# EasyEDA Pro project Access Control Core.eprj, schematic Card Reader (continued)
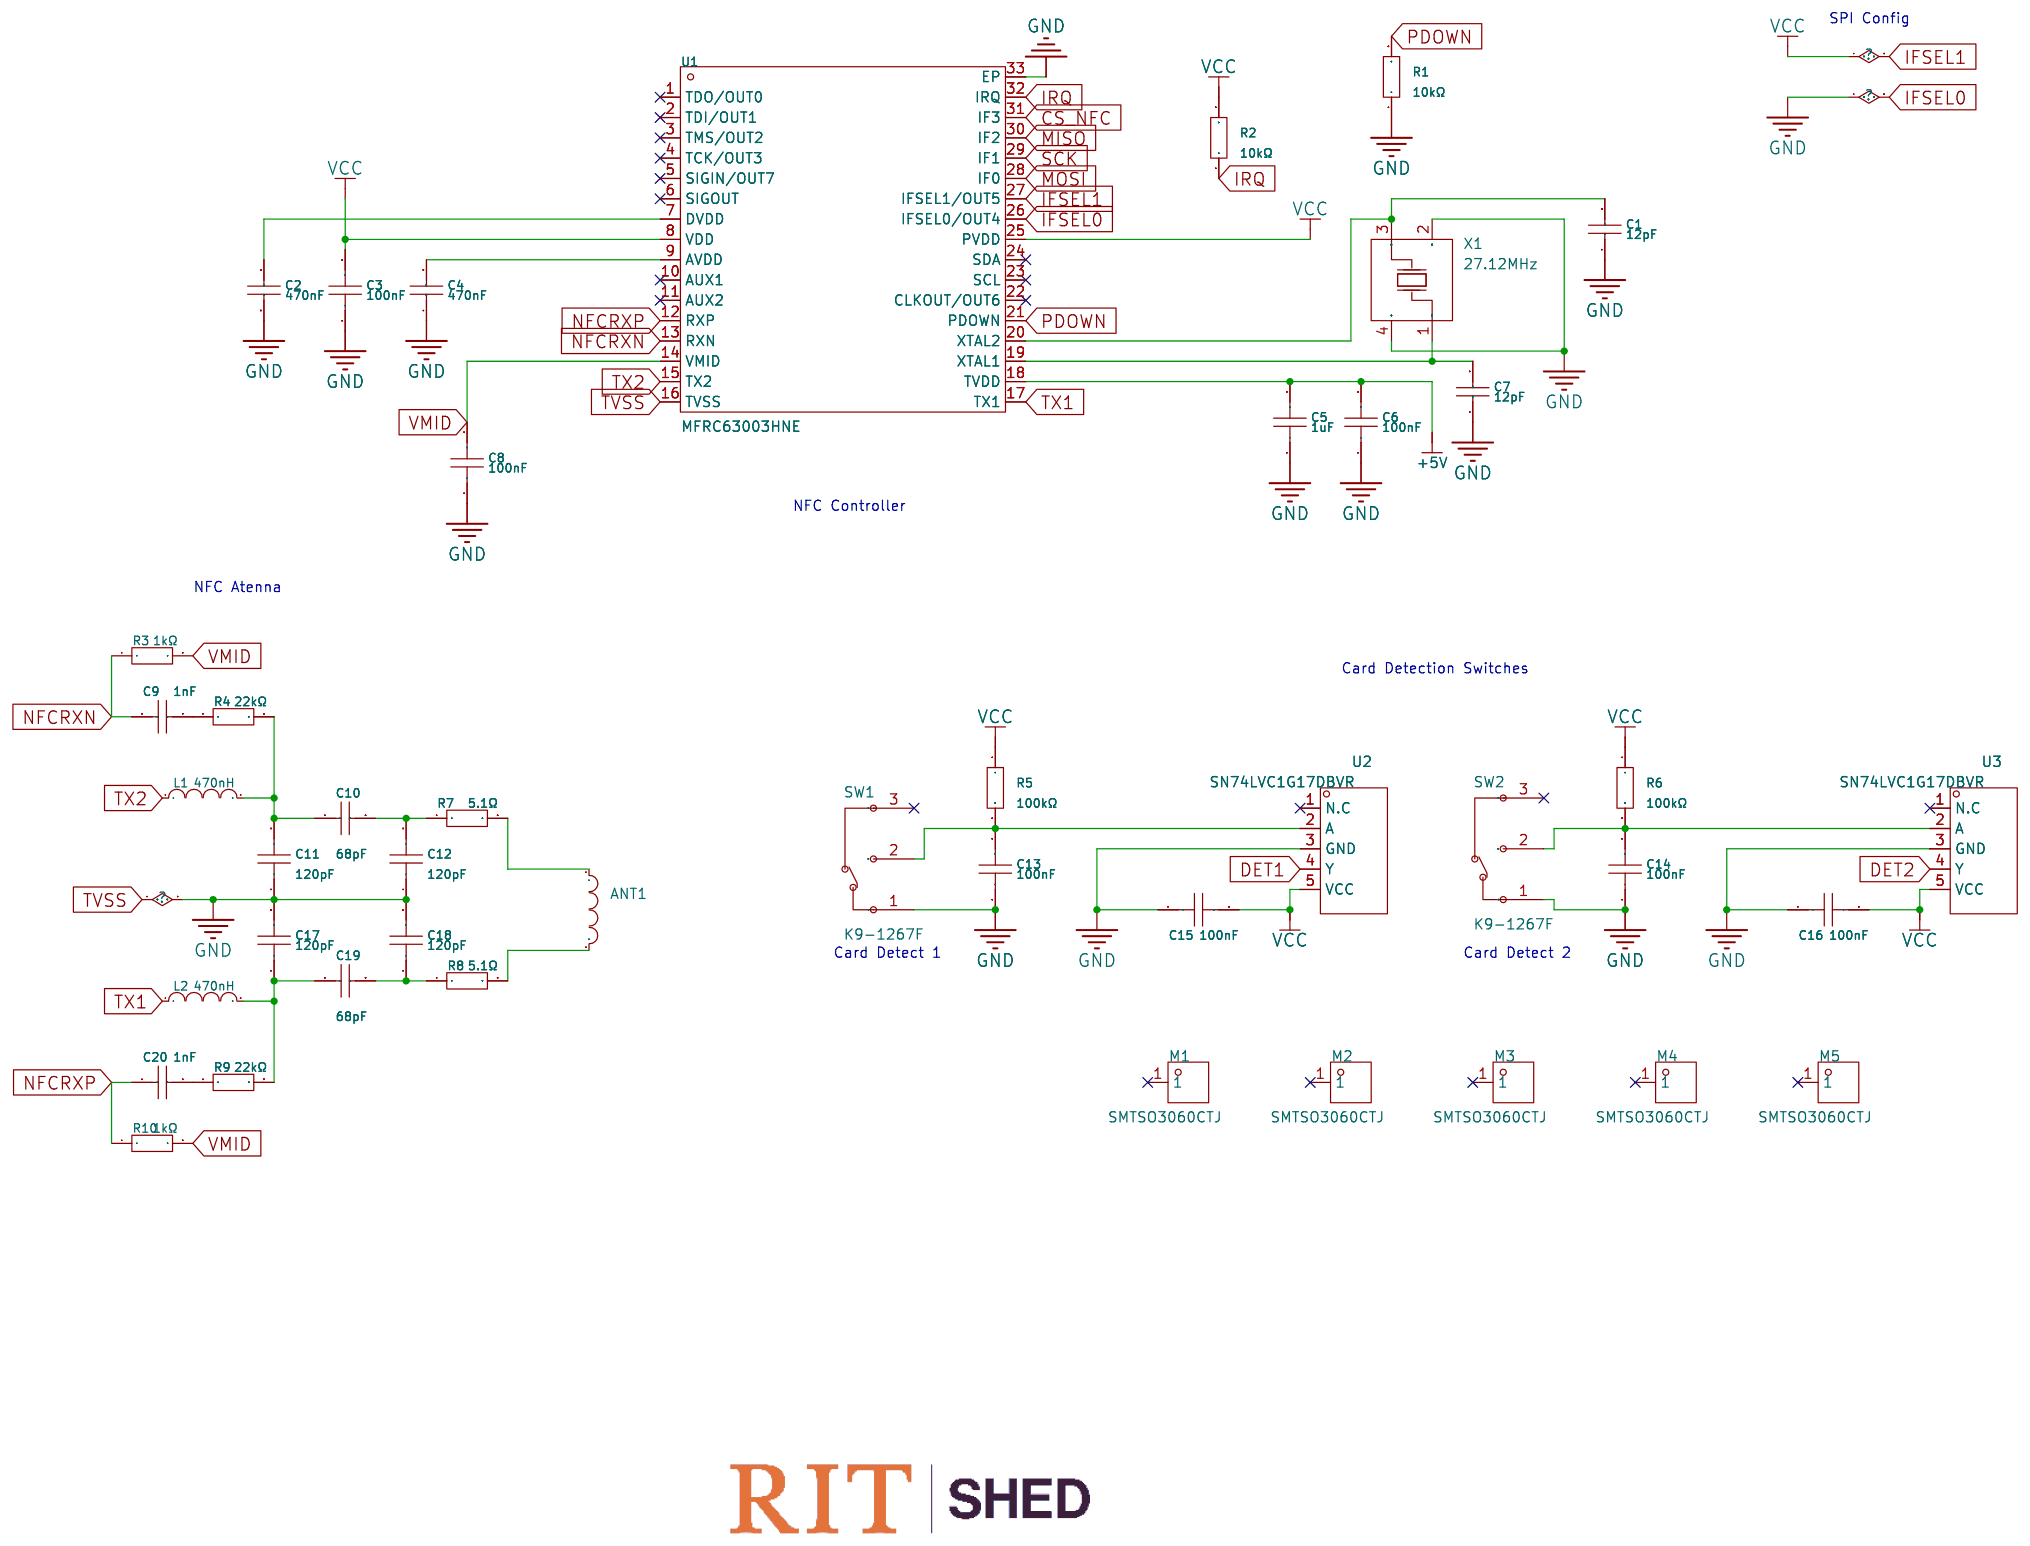
[diagram p0: NFC Reader]
## Library data of the parts (continued)
R38 = RTT031242FTP: Type:Thick Film Resistors Resistance: Tolerance:±1% Tolerance:±1% Power(Watts): Overload Voltage (Max): Temperature Coefficient:±100ppm/℃ Temperature Coefficient:±100ppm/℃ Operating Temperature Range:-55℃~+155℃ Operating Temperature Range:-55℃~+155℃; LCSC Part Name: 厚膜电阻 12.4kΩ ±1% 100mW; Supplier Part: C103261; Manufacturer: RALEC(旺诠); Supplier Footprint: 0603; JLCPCB Part Class: Extended Part; Datasheet: https://atta.szlcsc.com/upload/public/pdf/source/20191219/C158410_884373A5B7E1BC76BF57BC45A946C093.pdf; Supplier: LCSC; Type: Thick Film Resistors; Tolerance: ±1%; Temperature Coefficient: ±100ppm/℃; Operating Temperature Range: -55℃~+155℃
R40 R41 R47 R48 = RC0603DR-0749R9L: 100mW Thick Film Resistors ±100ppm/℃ ±0.5% 49.9Ω 0603  Chip Resistor - Surface Mount ROHS; LCSC Part Name: C859049; Supplier Part: C859049; Manufacturer: UNI-ROYAL(厚声); Manufacturer Part: 0603WAF1002T5E; Supplier Footprint: 0603; JLCPCB Part Class: Extended Part; Datasheet: https://atta.szlcsc.com/upload/public/pdf/source/20200306/C422600_1E6D84923E4A46A82E41ADD87F860B5C.pdf; Supplier: LCSC; Type: Thick Film Resistors; Tolerance: ±1%; Temperature Coefficient: ±100ppm/℃; Operating Temperature Range: -55℃~+155℃
R43 = 0603WAF100JT5E: Type:Thick Film Resistors Resistance:10Ω Tolerance:±1% Tolerance:±1% Power(Watts): Overload Voltage (Max): Temperature Coefficient:±400ppm/℃ Temperature Coefficient:±400ppm/℃ Operating Temperature Range:-55℃~+155℃ Operating Temperature Range:-55℃~+155℃; LCSC Part Name: 10Ω ±1% 100mW 厚膜电阻; Supplier Part: C22859; Manufacturer: UNI-ROYAL(厚声); Supplier Footprint: 0603; JLCPCB Part Class: Basic Part; Datasheet: https://atta.szlcsc.com/upload/public/pdf/source/20200306/C422600_1E6D84923E4A46A82E41ADD87F860B5C.pdf; Supplier: LCSC; Type: Thick Film Resistors; Tolerance: ±1%; Temperature Coefficient: ±400ppm/℃; Operating Temperature Range: -55℃~+155℃
R3 R10 R33 R34 R36 R44 R46 R58 R59 R61 = 0603WAF1001T5E: Type:Thick Film Resistors Resistance:1kΩ Tolerance:±1% Tolerance:±1% Power(Watts): Overload Voltage (Max): Temperature Coefficient:±100ppm/℃ Temperature Coefficient:±100ppm/℃ Operating Temperature Range:-55℃~+155℃ Operating Temperature Range:-55℃~+155℃; LCSC Part Name: 1kΩ ±1% 100mW 厚膜电阻; Supplier Part: C21190; Manufacturer: UNI-ROYAL(厚声); Supplier Footprint: 0603; JLCPCB Part Class: Basic Part; Datasheet: https://atta.szlcsc.com/upload/public/pdf/source/20200306/C422600_1E6D84923E4A46A82E41ADD87F860B5C.pdf; Supplier: LCSC; Type: Thick Film Resistors; Tolerance: ±1%; Temperature Coefficient: ±100ppm/℃; Operating Temperature Range: -55℃~+155℃
R45 = 0603WAF1004T5E: Type:Thick Film Resistors Resistance:1MΩ Tolerance:±1% Tolerance:±1% Power(Watts): Overload Voltage (Max): Temperature Coefficient:±100ppm/℃ Temperature Coefficient:±100ppm/℃ Operating Temperature Range:-55℃~+155℃ Operating Temperature Range:-55℃~+155℃; LCSC Part Name: 1MΩ ±1% 100mW 厚膜电阻; Supplier Part: C22935; Manufacturer: UNI-ROYAL(厚声); Supplier Footprint: 0603; JLCPCB Part Class: Basic Part; Datasheet: https://atta.szlcsc.com/upload/public/pdf/source/20200306/C422600_1E6D84923E4A46A82E41ADD87F860B5C.pdf; Supplier: LCSC; Type: Thick Film Resistors; Tolerance: ±1%; Temperature Coefficient: ±100ppm/℃; Operating Temperature Range: -55℃~+155℃
U16 = SN74AHC1G125DBVR: Input type:- output type:Tri-State Supply Voltage:2V~5.5V Supply Voltage:2V~5.5V Number of Elements:1 Number of Bits per Element:1 Sink Current:8mA Source Current:8mA Logic Family:74AHC Operating Temperature:-40℃~+125℃ Operating Temperature:-40℃~+125℃; Supplier Part: C7468; Manufacturer: TI(德州仪器); Supplier Footprint: SOT-23-5; JLCPCB Part Class: Extended Part; Datasheet: https://www.ti.com/cn/lit/gpn/sn74ahc1g125; Supplier: LCSC; output type: Tri-State; Supply Voltage: 2V~5.5V; Number of Elements: 1; Number of Bits per Element: 1; Sink Current: 8mA; Source Current: 8mA; Logic Family: 74AHC; Operating Temperature: -40℃~+125℃
U17 = W5500: LCSC Part Name: 硬连线TCP/IP嵌入式以太网控制器; Supplier Part: C32843; Manufacturer: WIZNET; Supplier Footprint: LQFP-48(7x7); JLCPCB Part Class: Extended Part; Datasheet: https://atta.szlcsc.com/upload/public/pdf/source/20230714/E10C32B058E0BA54FCE1C1556BE10C07.pdf; Supplier: LCSC
X2 = X322525MOB4SI: Type:Surface Mount Crystal Frequency:25MHz Normal temperature Frequency Tolerance:±10ppm Normal temperature Frequency Tolerance:±10ppm Load Capacitance:12pF Frequency Stability:±20ppm Frequency Stability:±20ppm Operating Temperature:-40℃~+85℃ Operating Te; LCSC Part Name: YSX321SL 25MHZ 4P 3225 12PF ±10PPM -40~85℃ (±20PPM); Supplier Part: C9006; Manufacturer: YXC(扬兴晶振); Supplier Footprint: SMD3225-4P; JLCPCB Part Class: Basic Part; Datasheet: https://atta.szlcsc.com/upload/public/pdf/source/20240329/19D5F850207469550BEB00D7DFEDBC7A.pdf; Supplier: LCSC; Type: Surface Mount Crystal; Normal temperature Frequency Tolerance: ±10ppm; Load Capacitance: 12pF; Frequency Stability: ±20ppm; Operating Temperature: -40℃~+85℃
C21 C22 C56 = CL31A476MPHNNNE: LCSC Part Name: 47uF ±20% 10V; Supplier Part: C96123; Manufacturer: SAMSUNG(三星); Supplier Footprint: 1206; Datasheet: https://item.szlcsc.com/datasheet/CL31A476MPHNNNE/97327.html; Supplier: LCSC; Tolerance: ±20%; Voltage Rating: 10V; Temperature Coefficient: X5R
C5 C92 C100 C102 = CL10A105KB8NNNC: Capacitance: Tolerance:±10% Tolerance:±10% Voltage Rated: Temperature Coefficient:; LCSC Part Name: 1uF ±10% 50V; Supplier Part: C15849; Manufacturer: SAMSUNG(三星); Supplier Footprint: 0603; JLCPCB Part Class: Basic Part; Datasheet: https://atta.szlcsc.com/upload/public/pdf/source/20160218/1457707763339.pdf; Supplier: LCSC; Tolerance: ±10%
CN2 = B-3002N14P-0110: LCSC Part Name: 2mm 2x7P 排数:2 每排P数:7; Supplier Part: C383681; Manufacturer: Ckmtw(灿科盟); Supplier Footprint: SMD,P=2mm; JLCPCB Part Class: Extended Part; Datasheet: https://item.szlcsc.com/datasheet/B-3002N14P-0110/356941.html; Supplier: LCSC; Connector Type: IDC Header; Pitch: 2mm; Number of Positions or Pins: 2x7P; Holder Type: Surface Mount,Vertical; Row Spacing: 2mm; Number of Rows: 2; Number of PINs Per Row: 7; Contact Material: Brass; Contact Plating: Gold
F1 F2 F5 F7 = SMD1206B050TF: LCSC Part Name: 6V 500mA 贴片自恢复; Supplier Part: C269115; Manufacturer: Brightking(君耀电子); Supplier Footprint: 1206; JLCPCB Part Class: Extended Part; Datasheet: https://item.szlcsc.com/datasheet/SMD1206B050TF/258573.html; Supplier: LCSC; Voltage - Max: 6V; Current - Max: 100A; Hold Current: 500mA; Trip Current: 1A; Power Dissipation: 600mW; Resistance - Initial (Ri) (Min): 150mΩ; Resistance - Post Trip (R1) (Max): 700mΩ; Time to Trip(Max): 100ms; Operating Temperature: -40℃~+85℃; Length: 3.4mm; Width: 1.8mm; Height: 0.85mm
J1 = HC-GAP-ACF012-1T: LCSC Part Name: Type-C 母 侧插; Supplier Part: C2894906; Manufacturer: HCTL(华灿天禄); Supplier Footprint: 插件; Datasheet: https://item.szlcsc.com/datasheet/HC-GAP-ACF012-1T/3132582.html; Supplier: LCSC; Connector Type: Type-C; Gender: Female; Mounting Type: Vertical, Flag; Number of Contacts: 14P; Number of Ports: 1; Current Rating-Power: 5A; Voltage Rating: 5V; Connect-Disconnect Life: 10,000 cycles; Detection color: Black; Operating Temperature: -25℃~+85℃
R5 R6 R11 = 0603WAF1003T5E: Type:Thick Film Resistor Resistance:100kΩ Tolerance:±1% Tolerance:±1% Power(Watts):100mW Voltage-Supply(Max):75V Temperature Coefficient:±100ppm/℃ Temperature Coefficient:±100ppm/℃ Operating Temperature:-55℃~+155℃ Operating Temperature:-55℃~+155℃; LCSC Part Name: 100kΩ ±1% 100mW 厚膜电阻; Supplier Part: C25803; Manufacturer: UNI-ROYAL(厚声); Supplier Footprint: 0603; JLCPCB Part Class: Basic Part; Datasheet: https://item.szlcsc.com/datasheet/0603WAF1003T5E/26546.html; Supplier: LCSC; Type: Thick Film Resistor; Tolerance: ±1%; Power(Watts): 100mW; Voltage-Supply(Max): 75V; Temperature Coefficient: ±100ppm/℃; Operating Temperature: -55℃~+155℃; Operating Temperature Range: -55℃~+155℃
R13 R14 = 0603WAF5101T5E: LCSC Part Name: 5.1kΩ ±1% 100mW 厚膜电阻; Supplier Part: C23186; Manufacturer: UNI-ROYAL(厚声); Supplier Footprint: 0603; Datasheet: https://item.szlcsc.com/datasheet/0603WAF5101T5E/23913.html; Supplier: LCSC; Type: Thick Film Resistor; Tolerance: ±1%; Power(Watts): 100mW; Voltage-Supply(Max): 75V; Temperature Coefficient: ±100ppm/℃; Operating Temperature: -55℃~+155℃
SW3 = TS-1045-A13B3-D2: Circuit:SPST Actuator Style:Round Button Operating Force:250gf Mounting Style:卧贴 Switch Height:10mm Strike Gundam:带支架 Actuator/Cap Color:Black Pin Style:SMDSplicing Mechanical Life:-; LCSC Part Name: 轻触开关6*6*10带支架贴片支架侧按按键250gf; Supplier Part: C557898; Manufacturer: Yuandi(元迪); Supplier Footprint: SMD; JLCPCB Part Class: Extended Part; Datasheet: https://atta.szlcsc.com/upload/public/pdf/source/20200522/C557886_6DF50336386BA259B6638E5ADB1DAB20.pdf; Supplier: LCSC; Circuit: SPST; Actuator Style: Round Button; Operating Force: 250gf; Mounting Style: 卧贴; Switch Height: 10mm; Strike Gundam: 带支架; Actuator/Cap Color: Black; Pin Style: SMDSplicing
U2-U4 = SN74LVC1G17DBVR: Input type:Schmitt Trigger output type:推挽 Supply Voltage:1.65V~5.5V Supply Voltage:1.65V~5.5V Number of Elements:1 Number of Bits per Element:1 Sink Current:32mA Source Current:32mA Logic Family:74LVC Operating Temperature:-40℃~+125℃ Operating Temperature; Supplier Part: C7836; Manufacturer: TI(德州仪器); Supplier Footprint: SOT-23-5; JLCPCB Part Class: Extended Part; Datasheet: https://www.ti.com/cn/lit/gpn/sn74lvc1g17; Supplier: LCSC; Input type: Schmitt Trigger; output type: 推挽; Supply Voltage: 1.65V~5.5V; Number of Elements: 1; Number of Bits per Element: 1; Sink Current: 32mA; Source Current: 32mA; Logic Family: 74LVC; Operating Temperature: -40℃~+125℃; NO_CONNECT: yes
U5 = TMP112AIDRLR: Supplier Part: C28927; Manufacturer: TI(德州仪器); Supplier Footprint: SOT-563; JLCPCB Part Class: Extended Part; Datasheet: https://www.ti.com/cn/lit/gpn/tmp112; Supplier: LCSC; Temperature Range: -40℃~+125℃; Tolerance: ±0.5℃; Voltage - Supply: 1.4V~3.6V; Standby Current: 1uA; Interface: I2C
U6 = LIS2DH12TR: Supplier Part: C110926; Manufacturer: ST(意法半导体); Supplier Footprint: LGA-12(2x2); Datasheet: https://item.szlcsc.com/datasheet/LIS2DH12TR/112151.html; Supplier: LCSC; Accelerometer Sensing Axis: X,Y,Z; Acceleration Measurement Range (MAX): ±16g; Sensor Type: Accelerometer; Interface: I2C；SPI; Voltage - Supply: 1.71V~3.6V; Standby Current: 500nA; Operating Temperature: -40℃~+85℃
U21 U22 = MX66100T: LCSC Part Name: 1V to 5.5V、2A、100mΩ理想二极管; Supplier Part: C53121238; Manufacturer: Wuxi Maxinmicro(无锡明芯微); Supplier Footprint: SOT23-6; JLCPCB Part Class: Extended Part; Datasheet: https://item.szlcsc.com/datasheet/MX66100T/56102987.html; Supplier: LCSC
H1 = HDR-M_2.54_1x4P: Supplier Footprint: Through
LED3 = KT-0603R: LCSC Part Name: 0603 红灯 高亮; Supplier Part: C2286; Manufacturer: KENTO; Supplier Footprint: 0603; Datasheet: https://atta.szlcsc.com/upload/public/pdf/source/20160616/1466072038404.pdf; Supplier: LCSC; Emitted Color: Red; Operating Temperature: -40℃~+85℃
U23 = ESP32-S3-MINI-1-N8: Supplier Part: C2913206; Manufacturer: ESPRESSIF(乐鑫); Supplier Footprint: SMD; Datasheet: https://atta.szlcsc.com/upload/public/pdf/source/20220425/7F117D7A09F85946280540FD9EFDF9F3.pdf; Supplier: LCSC; Core Processor: ESP32-S3FN8 Chip; Support Interface: I2C；GPIO；SPI；PWM；ADC；UART；USB；I2S; Output Power: 20.5dBm
ANT1 = NFC Antenna: 40x54mm, 1270um track, 508um gap, 35um track thickness, 4 turn, 1.66 turn exponent, NXP calls it a 1445nH, 2.4pF, 0.95R antenna.
C1 C7 = CL10C120JB8NNNC: Capacitance: Tolerance:±5% Tolerance:±5% Voltage Rated: Temperature Coefficient:; LCSC Part Name: 12pF ±5% 50V; Supplier Part: C38523; Manufacturer: SAMSUNG(三星); Supplier Footprint: 0603; JLCPCB Part Class: Basic Part; Datasheet: https://atta.szlcsc.com/upload/public/pdf/source/20160218/1457707763339.pdf; Supplier: LCSC; Tolerance: ±5%
C2 C4 = CL10B474KA8NNNC: Capacitance: Tolerance:±10% Tolerance:±10% Voltage Rated: Temperature Coefficient:; LCSC Part Name: 470nF ±10% 25V; Supplier Part: C1623; Manufacturer: SAMSUNG(三星); Supplier Footprint: 0603; JLCPCB Part Class: Basic Part; Datasheet: https://atta.szlcsc.com/upload/public/pdf/source/20160218/1457707763339.pdf; Supplier: LCSC; Tolerance: ±10%
C9 C20 = CL10B102KB8NNNC: Capacitance: Tolerance:±10% Tolerance:±10% Voltage Rated: Temperature Coefficient:; LCSC Part Name: 1nF ±10% 50V; Supplier Part: C1588; Manufacturer: SAMSUNG(三星); Supplier Footprint: 0603; JLCPCB Part Class: Basic Part; Datasheet: https://atta.szlcsc.com/upload/public/pdf/source/20160218/1457707763339.pdf; Supplier: LCSC; Tolerance: ±10%
C10 C19 = CL10C680JB8NNNC: Capacitance: Tolerance:±5% Tolerance:±5% Voltage Rated: Temperature Coefficient:; LCSC Part Name: 68pF ±5% 50V; Supplier Part: C28262; Manufacturer: SAMSUNG(三星); Supplier Footprint: 0603; JLCPCB Part Class: Extended Part; Datasheet: https://atta.szlcsc.com/upload/public/pdf/source/20160218/1457707763339.pdf; Supplier: LCSC; Tolerance: ±5%
C11 C12 C17 C18 = CL10C121JB8NNNC: Capacitance: Tolerance:±5% Tolerance:±5% Voltage Rated: Temperature Coefficient:; LCSC Part Name: 120pF ±5% 50V; Supplier Part: C18438; Manufacturer: SAMSUNG(三星); Supplier Footprint: 0603; JLCPCB Part Class: Extended Part; Datasheet: https://atta.szlcsc.com/upload/public/pdf/source/20160218/1457707763339.pdf; Supplier: LCSC; Tolerance: ±5%
L1 L2 = MLP1608VR47DT0S1: Inductance: Tolerance:±20% Tolerance:±20% Rated Current: Saturation Current (Isat):- DC Resistance (DCR): Q @ Freq:- Frequency - Self Resonant:- Ratings:; LCSC Part Name: 470nH ±20%; Supplier Part: C105533; Manufacturer: TDK; Supplier Footprint: 0603; Datasheet: https://atta.szlcsc.com/upload/public/pdf/source/20180702/C105533_29B6B2DE07EC923A72FED272F110324B.pdf; Supplier: LCSC; Tolerance: ±20%
M1-M5 = SMTSO3060CTJ: LCSC Part Name: 雄和远景，电路板表贴圆螺母柱，M3X6，铜镀锡,1个; Supplier Part: C2915637; Manufacturer: Sinhoo(雄和远景); JLCPCB Part Class: Extended Part; Datasheet: https://atta.szlcsc.com/upload/public/pdf/source/20211122/17CF5E24EB4D4DC090A80DE3D7DE5E21.pdf; Supplier: LCSC; specifications: M3X6; surface treatment: 镀锡; brand: Sinhoo(雄和远景)
R4 R9 R30 = 0603WAF2202T5E: Type:Thick Film Resistors Resistance:22kΩ Tolerance:±1% Tolerance:±1% Power(Watts): Overload Voltage (Max): Temperature Coefficient:±100ppm/℃ Temperature Coefficient:±100ppm/℃ Operating Temperature Range:-55℃~+155℃ Operating Temperature Range:-55℃~+155℃; LCSC Part Name: 22kΩ ±1% 100mW 厚膜电阻; Supplier Part: C31850; Manufacturer: UNI-ROYAL(厚声); Supplier Footprint: 0603; Datasheet: https://atta.szlcsc.com/upload/public/pdf/source/20200306/C422600_1E6D84923E4A46A82E41ADD87F860B5C.pdf; Supplier: LCSC; Type: Thick Film Resistors; Tolerance: ±1%; Temperature Coefficient: ±100ppm/℃; Operating Temperature Range: -55℃~+155℃
R7 R8 = 0603WAF510KT5E: Type:Thick Film Resistors Resistance:5.1Ω Tolerance:±1% Tolerance:±1% Power(Watts): Overload Voltage (Max): Temperature Coefficient:±200ppm/℃ Temperature Coefficient:±200ppm/℃ Operating Temperature Range:-55℃~+155℃ Operating Temperature Range:-55℃~+155℃; LCSC Part Name: 5.1Ω ±1% 100mW 厚膜电阻; Supplier Part: C25197; Manufacturer: UNI-ROYAL(厚声); Supplier Footprint: 0603; JLCPCB Part Class: Basic Part; Datasheet: https://atta.szlcsc.com/upload/public/pdf/source/20200306/C422600_1E6D84923E4A46A82E41ADD87F860B5C.pdf; Supplier: LCSC; Type: Thick Film Resistors; Tolerance: ±1%; Temperature Coefficient: ±200ppm/℃; Operating Temperature Range: -55℃~+155℃
SW1 SW2 = K9-1267F: Type:Micro Switch Circuit:SPDT Switch Length:12.7mm Switch Width:5.7mm Switch Height:12.8mm Contact Current (DC):100mA Voltage Rating (DC):30V Contact Current (AC):1A Voltage Rating (AC):125V Mechanical Life:300万次 Operating Temperature:-25℃~+85℃ Operating; LCSC Part Name: 12.7*5.7*12.8mm 插件微动开关; Supplier Part: C107263; Manufacturer: 韩国韩荣; Supplier Footprint: 插件; JLCPCB Part Class: Extended Part; Datasheet: https://atta.szlcsc.com/upload/public/pdf/source/20201214/C107263_D9656DE761E5BF43078859A56D7E33A8.pdf; Supplier: LCSC; Type: Micro Switch; Circuit: SPDT; Switch Length: 12.7mm; Switch Width: 5.7mm; Switch Height: 12.8mm; Contact Current (DC): 100mA; Voltage Rating (DC): 30V; Contact Current (AC): 1A; Voltage Rating (AC): 125V; Mechanical Life: 300万次; Operating Temperature: -25℃~+85℃
U1 = MFRC63003HNE: Supplier Part: C1526298; Manufacturer: NXP(恩智浦); Supplier Footprint: HVQFN-32-EP(5x5); JLCPCB Part Class: Extended Part; Datasheet: https://atta.szlcsc.com/upload/public/pdf/source/20230811/188CF1E38A54086FF38BC20E6B5F5B97.pdf; Supplier: LCSC
X1 = X32252712MMB4SI: Crystal Type:Surface Mount Crystal Frequency: Normal temperature Frequency Tolerance:±10ppm Normal temperature Frequency Tolerance:±10ppm Load Capacitance: Frequency Stability:±20ppm Frequency Stability:±20ppm Operating Temperature: Operating Temperature:; LCSC Part Name: 27.12MHz ±10ppm 10pF; Supplier Part: C29975; Manufacturer: YXC(扬兴晶振); Supplier Footprint: SMD3225-4P; JLCPCB Part Class: Extended Part; Datasheet: https://atta.szlcsc.com/upload/public/pdf/source/20240329/19D5F850207469550BEB00D7DFEDBC7A.pdf; Supplier: LCSC; Crystal Type: Surface Mount Crystal; Normal temperature Frequency Tolerance: ±10ppm; Frequency Stability: ±20ppm
C51 = 0603CG300J500NT: LCSC Part Name: 30pF ±5% 50V; Supplier Part: C1658; Manufacturer: FH(风华); Supplier Footprint: 0603; Datasheet: https://item.szlcsc.com/datasheet/0603CG300J500NT/2010.html; Supplier: LCSC; Tolerance: ±5%; Voltage Rating: 50V; Temperature Coefficient: C0G
C59 C71 = CL10B333KB8NNNC: LCSC Part Name: 33nF ±10% 50V; Supplier Part: C21117; Manufacturer: SAMSUNG(三星); Supplier Footprint: 0603; Datasheet: https://item.szlcsc.com/datasheet/CL10B333KB8NNNC/21829.html; Supplier: LCSC; Tolerance: ±10%; Voltage Rating: 50V; Temperature Coefficient: X7R
D6-D8 = B5819W SL: LCSC Part Name: 电压:40V 电流:1A; Supplier Part: C8598; Manufacturer: CJ(江苏长电/长晶); Supplier Footprint: SOD-123; Datasheet: https://item.szlcsc.com/datasheet/B5819W%2520SL/9093.html; Supplier: LCSC; Voltage - Forward(Vf@If): 600mV@1A; Voltage - DC Reverse(Vr): 40V; Current - Rectified: 1A; Non-Repetitive Peak Forward Surge Current: 9A
L3 L4 = PSPMAA0605H-4R7M-ANP: LCSC Part Name: 4.7uH ±20% 12A; Supplier Part: C2983090; Manufacturer: PROD(谱罗德); Supplier Footprint: SMD,7.1x6.6mm; JLCPCB Part Class: Extended Part; Datasheet: https://item.szlcsc.com/datasheet/PSPMAA0605H-4R7M-ANP/3416342.html; Supplier: LCSC; Tolerance: ±20%; Current Rating: 7A; Current - Saturation(Isat): 12A; DC Resistance(DCR): 29mΩ
R35 = 0603WAF5102T5E: LCSC Part Name: 51kΩ ±1% 100mW 厚膜电阻; Supplier Part: C23196; Manufacturer: UNI-ROYAL(厚声); Supplier Footprint: 0603; JLCPCB Part Class: Basic Part; Datasheet: https://item.szlcsc.com/datasheet/0603WAF5102T5E/23923.html; Supplier: LCSC; Type: Thick Film Resistor; Tolerance: ±1%; Power(Watts): 100mW; Voltage-Supply(Max): 75V; Temperature Coefficient: ±100ppm/℃; Operating Temperature: -55℃~+155℃
U13 U15 = TPS62933DRLR: Supplier Part: C3200405; Manufacturer: TI(德州仪器); Supplier Footprint: SOT-583; Datasheet: https://www.ti.com/cn/lit/gpn/tps62933f; Supplier: LCSC; Function: Step-down type; Output Type: Adjustable; Input Voltage: 3.8V~30V; Output Voltage: 800mV~22V; Output Current: 3A; Switching Frequency: 2.2MHz; Operating Temperature: -40℃~+150℃@(TJ); Synchronous Rectification: Yes; Number of Outputs: 1; Topology: Step-down; Switch tube (built-in/external): Built-in
BZR1 = MLT-8540: Supplier Part: C95300; Manufacturer: 华能; Supplier Footprint: SMD,8.7x8.7mm; JLCPCB Part Class: Extended Part; Datasheet: https://atta.szlcsc.com/upload/public/pdf/source/20170522/1495448323732.pdf; Supplier: LCSC; Driver Circuitry: Passive (external drive); Technology: Electromagnetic Type; Voltage - Supply: 2.5V~4.5V; Sound Pressure Level(SPL): 80dB; Length: 8.7mm; Width: 8.7mm; Height: 4mm
LED1 = WS2812D-F8: LCSC Part Name: RGB三色; Supplier Part: C139126; Manufacturer: worldsemi; Supplier Footprint: 插件,D=8mm; Datasheet: https://atta.szlcsc.com/upload/public/pdf/source/20171116/C139126_15108221280701123735.pdf; Supplier: LCSC; Note: Tap Pad
LED2 = WS2812D-F8: LCSC Part Name: RGB三色; Supplier Part: C139126; Manufacturer: worldsemi; Supplier Footprint: 插件,D=8mm; Datasheet: https://atta.szlcsc.com/upload/public/pdf/source/20171116/C139126_15108221280701123735.pdf; Supplier: LCSC; Note: Card Slot
Q1 = S8050 J3Y(RANGE:200-350): LCSC Part Name: H档(200-350) NPN 电流:0.5A 电压:25V; Supplier Part: C2146; Manufacturer: CJ(江苏长电/长晶); Supplier Footprint: SOT-23; JLCPCB Part Class: Basic Part; Datasheet: https://item.szlcsc.com/datasheet/S8050%2520J3Y(RANGE%253A200-350)/2503.html; Supplier: LCSC; type: NPN; Current - Collector(Ic): 500mA; Collector - Emitter Voltage VCEO: 25V; Pd - Power Dissipation: 300mW; DC Current Gain: 200@500mA,1V; Transition frequency(fT): 150MHz; Current - Collector Cutoff: 100nA; Vce Saturation(VCE(sat)): 600mV@500mA,50mA; Operating Temperature: -55℃~+150℃; Emitter-Base Voltage(Vebo): 5V; Number: 1 NPN; Note: (RANGE:200-350)
R55 = 0805W8F0000T5E_C17477: Type:Thick Film Resistor Resistance:0Ω Tolerance:±1% Tolerance:±1% Power(Watts):125mW Voltage-Supply(Max):150V Temperature Coefficient:±800ppm/℃ Temperature Coefficient:±800ppm/℃ Operating Temperature:-55℃~+155℃ Operating Temperature:-55℃~+155℃; LCSC Part Name: 0Ω ±1% 125mW 厚膜电阻; Supplier Part: C17477; Manufacturer: UNI-ROYAL(厚声); Manufacturer Part: 0805W8F0000T5E; Supplier Footprint: 0805; Datasheet: https://item.szlcsc.com/datasheet/0805W8F0000T5E/18165.html; Supplier: LCSC; Type: Thick Film Resistor; Tolerance: ±1%; Power(Watts): 125mW; Voltage-Supply(Max): 150V; Temperature Coefficient: ±800ppm/℃; Operating Temperature: -55℃~+155℃; Note: SLOT
R56 = 0805W8F0000T5E_C17477: Type:Thick Film Resistor Resistance:0Ω Tolerance:±1% Tolerance:±1% Power(Watts):125mW Voltage-Supply(Max):150V Temperature Coefficient:±800ppm/℃ Temperature Coefficient:±800ppm/℃ Operating Temperature:-55℃~+155℃ Operating Temperature:-55℃~+155℃; LCSC Part Name: 0Ω ±1% 125mW 厚膜电阻; Supplier Part: C17477; Manufacturer: UNI-ROYAL(厚声); Manufacturer Part: 0805W8F0000T5E; Supplier Footprint: 0805; Datasheet: https://item.szlcsc.com/datasheet/0805W8F0000T5E/18165.html; Supplier: LCSC; Type: Thick Film Resistor; Tolerance: ±1%; Power(Watts): 125mW; Voltage-Supply(Max): 150V; Temperature Coefficient: ±800ppm/℃; Operating Temperature: -55℃~+155℃; Note: PAD
R57 = 0603WAF750JT5E: LCSC Part Name: 75Ω ±1% 100mW 厚膜电阻; Supplier Part: C4275; Manufacturer: UNI-ROYAL(厚声); Supplier Footprint: 0603; Datasheet: https://item.szlcsc.com/datasheet/0603WAF750JT5E/4682.html; Supplier: LCSC; Type: Thick Film Resistor; Tolerance: ±1%; Power(Watts): 100mW; Voltage-Supply(Max): 75V; Temperature Coefficient: ±100ppm/℃; Operating Temperature: -55℃~+155℃

## Nets
+5V: C5.2 C6.2 C32.2 C34.2 C36.2 C40.2 C42.2 C43.2 C44.2 C96.2 C97.2 C99.2 C101.2 D7.2(+) F1.1 F4.1 F7.1 LED1.2(VDD) LED2.2(VDD) R44.2 R46.2 U1.18(TVDD) U8.6(VCCB) U9.6(VCCB) U10.6(VCCB) U11.6(VCCB) U12.1(VCCA) U20.1(VCCA) U21.6(VOUT) U22.6(VOUT)
+5V-BUS: C39.2 D5.5 F4.2 J2.6 J2.13
+12V: C46.2 C47.2 C48.2 C49.2 C50.2 C63.2 C64.2 C65.2 D6.2(+) F3.1 U15.3(VIN)
+12V-BUS: C38.2 D2.1(C) F3.2 J2.4 J2.5
AVDD: C76.2 C77.2 C78.2 C79.2 C80.2 C81.2 C82.2 FB2.2 R40.2 R41.2 R43.2 U17.4(AVDD) U17.8(AVDD) U17.11(AVDD) U17.15(AVDD) U17.17(AVDD) U17.21(AVDD)
GND: C1.1 C2.2 C3.1 C4.1 C5.1 C6.1 C7.1 C8.1 C11.1 C12.1 C13.1 C14.1 C15.1 C16.1 C17.2 C18.2 C21.2 C22.1 C23.1 C24.1 C25.1 C26.1 C27.1 C28.1 C32.1 C33.1 C34.1 C35.1 C36.1 C37.1 C38.1 C39.1 C40.1 C41.1 C42.1 C43.1 C44.1 C45.1 C46.1 C47.1 C48.1 C49.1 C50.1 C52.1 C53.1 C54.1 C55.1 C56.1 C57.1 C58.1 C59.2 C63.1 C64.1 C65.1 C66.1 C67.1 C68.1 C69.1 C70.1 C71.2 C73.1 C74.1 C75.2 C76.1 C77.1 C78.1 C79.1 C80.1 C81.1 C82.1 C83.2 C86.1 C87.1 C88.1 C89.2 C90.1 C92.1 C93.1 C94.1 C95.1 C96.1 C97.1 C98.1 C99.1 C100.1 C101.1 C102.1 CN2.12 CN2.13 CN2.14 D1.2 D2.2(A) D3.2 D4.2 D5.2 H1.2 J2.3 J2.10 J2.11 J2.14 J2.16 J2.17 J3.8 J3.13(SHELL) LED1.3(GND) LED2.3(GND) Q1.2(E) R1.1 R13.1 R14.1 R20.2 R21.2 R22.2 R23.2 R26.2 R27.2 R28.2 R32.2 R36.1 R38.1 R56.1 R59.1 R61.1 SW1.1(C) SW2.1(C) SW3.2 SW3.3(GND) U1.16(TVSS) U1.26(IFSEL0/OUT4) U1.33(EP) U2.3(GND) U3.3(GND) U4.3(GND) U5.2(GND) U5.4(ADD0) U6.5(RES) U6.6(GND) U6.7(GND) U6.8(GND) U8.2(GND) U9.2(GND) U10.2(GND) U11.2(GND) U12.2(GND) U12.5(DIR) U13.4(GND) U15.4(GND) U16.3(GND) U17.3(AGND) U17.9(AGND) U17.14(AGND) U17.16(AGND) U17.19(AGND) U17.23(RSVD) U17.29(GND) U17.48(AGND) U20.2(GND) U20.5(DIR) U21.2(GND) U22.2(GND) U23.1(GND) U23.2(GND) U23.42(GND) U23.43(GND) U23.46(GND) U23.47(GND) U23.48(GND) U23.49(GND) U23.50(GND) U23.51(GND) U23.52(GND) U23.53(GND) U23.54(GND) U23.55(GND) U23.56(GND) U23.57(GND) U23.58(GND) U23.59(GND) U23.60(GND) U23.GND X1.2(GND) X1.4(GND) X2.2(GND) X2.4(GND)
VCC: BZR1.1(+) C3.2 C15.2 C16.2 C24.2 C25.2 C26.2 C27.2 C28.2 C33.2 C35.2 C37.2 C41.2 C45.2 C51.2 C55.2 C56.2 C57.2 C58.2 C75.1 C93.2 C94.2 C95.2 C98.2 D8.1(-) F2.2 FB1.1 FB2.1 L3.2 R2.2 R5.1 R6.1 R11.1 R24.2 R25.2 R30.1 R37.1 R39.1 R42.1 R49.2 R52.1 R53.1 R55.2 U1.8(VDD) U1.25(PVDD) U1.27(IFSEL1/OUT5) U2.5(VCC) U3.5(VCC) U4.5(VCC) U5.5(V+) U6.2(CS) U6.3(SDO/SA0) U6.9(VDD) U6.10(VDD_IO) U8.1(VCCA) U9.1(VCCA) U10.1(VCCA) U11.1(VCCA) U12.6(VCCB) U16.5(VCC) U20.6(VCCB) U23.3(3V3)
VDD: C73.2 C74.2 FB1.2 U17.28(VDD)
ACCESS: J2.1 R26.1 U12.3(A)
ACCESS-SIG: R27.1 U12.4(B) U23.44(IO46)
BUSIO1: D5.4 J2.8 U8.4(B)
BUSIO2: D5.3 J2.9 U9.4(B)
BUSIO3: D5.6 J2.12 U10.4(B)
BUSIO4: D5.1 J2.15 U11.4(B)
BUTTON: U4.4(Y) U23.4(IO0)
BUZZER: R58.1 U23.5(IO1)
CC1: J1.A5(CC1) R13.2
CC2: J1.B5(CC2) R14.2
CS_NFC: U1.31(IF3) U23.28(IO33)
DEBUG-LED: LED3.2(A) U23.37(IO41)
DET1: U2.4(Y) U23.27(IO47)
DET2: U3.4(Y) U23.26(IO26)
DM: D1.1 D1.6 J1.A7(DN1) J1.B7(DN2) U23.23(IO19)
DP: D1.3 D1.4 J1.A6(DP1) J1.B6(DP2) U23.24(IO20)
ESP-EN: C92.2 R49.1 U23.45(EN)
ETH_CS: R42.2 U16.1(OE) U17.32(SCSn) U23.33(IO37)
ETH_INT: R39.2 U17.36(INTn) U23.18(IO14)
ETH_RST: R37.2 U17.37(RSTn) U23.34(IO38)
GPIO1: R16.2 U23.36(IO40)
GPIO2: R17.2 U23.35(IO39)
GPIO3: R18.2 U23.14(IO10)
GPIO4: R19.2 U23.6(IO2)
INTERRUPT: D4.1 J2.7 R25.1 R60.1
INTERRUPT-READ: R60.2 U23.25(IO21)
IODIR1: R20.1 U8.5(DIR) U23.32(IO36)
IODIR2: R21.1 U9.5(DIR) U23.38(IO42)
IODIR3: R22.1 U10.5(DIR) U23.9(IO5)
IODIR4: R23.1 U11.5(DIR) U23.41(IO45)
IRQ: R2.1 U1.32(IRQ) U23.10(IO6)
LED: U20.4(B) U23.11(IO7)
MISO: U1.30(IF2) U16.4(Y) U23.15(IO11)
MOSI: U1.28(IF0) U17.35(MOSI) U23.16(IO12)
NFCRXN: C9.1 R3.1 U1.13(RXN)
NFCRXP: C20.1 R10.1 U1.12(RXP)
ONEWIRE: CN2.11 D3.1 J2.2 R24.1 U23.22(IO18)
PDOWN: R1.2 U1.21(PDOWN) U23.8(IO4)
RX: H1.3 U23.40(RXD0)
RXN: C85.2 R48.2 U17.5(RXN)
RXP: C84.2 R47.2 U17.6(RXP)
SCK: U1.29(IF1) U17.33(SCLK) U23.17(IO13)
SCL: R52.2 U5.1(SCL) U6.1(SCL/SPC) U23.7(IO3)
SCREEN1: CN2.5 U23.21(IO17)
SCREEN2: CN2.7 U23.20(IO16)
SCREEN3: CN2.9 U23.19(IO15)
SCREEN4: CN2.6 U23.31(IO35)
SCREEN5: CN2.8 U23.30(IO48)
SCREEN6: CN2.10 U23.29(IO34)
SDA: R53.2 U5.6(SDA) U6.4(SDA/SDI/SDO) U23.13(IO9)
TX: H1.4 U23.39(TXD0)
TX1: L2.1 U1.17(TX1)
TX2: L1.1 U1.15(TX2)
TXN: J3.2 R41.1 U17.1(TXN)
TXP: J3.1 R40.1 U17.2(TXP)
VARIANT: R55.1 R56.2 U23.12(IO8)
VMID: C8.2 R3.2 R10.2 U1.14(VMID)
VUSB: D1.5 F5.1 J1.A4(VBUS) J1.A9(VBUS) J1.B4(VBUS) J1.B9(VBUS) R59.2
W_ACT: J3.11(D3+) U17.27(ACTLED)
W_LINK: J3.10(D2-) U17.25(LINKLED)
W_MISO: U16.2(A) U17.34(MISO)
W_XI: C89.1 R45.1 U17.30(XI/CLKIN) X2.3(OSC2)
W_XO: C83.1 R45.2 U17.31(XO) X2.1(OSC1)
$2N2483: C4.2 U1.9(AVDD)
$2N2484: C2.1 U1.7(DVDD)
$2N2490: C7.2 U1.19(XTAL1) X1.1(OSC1)
$2N2492: C1.2 U1.20(XTAL2) X1.3(OSC2)
$2N2516: C10.1 C11.2 L1.2 R4.2
$2N2517: C17.1 C19.1 L2.2 R9.2
$2N2518: C18.1 C19.2 R8.1
$2N2519: C10.2 C12.2 R7.1
$2N2522: ANT1.2 R8.2
$2N2523: ANT1.1 R7.2
$2N2526: C20.2 R9.1
$2N2527: C9.2 R4.1
$2N2535: C13.2 R5.2 SW1.2(NO) U2.2(A)
$2N2541: C14.2 R6.2 SW2.2(NO) U3.2(A)
$4N2195: C23.2 R11.2 SW3.1 U4.2(A)
$4N3264: C21.1 CN2.1 CN2.3 F1.2
$4N3267: C22.2 CN2.2 CN2.4 F2.1
$4N23713: C102.2 F5.2 U22.1(VIN) U22.3(ON)
$5N11060: R19.1 U11.3(A)
$5N11102: R18.1 U10.3(A)
$5N11144: R17.1 U9.3(A)
$5N11186: R16.1 U8.3(A)
$6N1500: C52.2 C53.2 C54.2 D6.1(-) D7.1(-) U13.3(VIN)
$6N1512: C60.1 U13.6(BST)
$6N1514: C60.2 L3.1 U13.5(SW)
$6N1519: C59.1 U13.7(SS)
$6N1532: C51.1 R28.1 R29.2 U13.8(FB)
$6N1538: R29.1 R30.2
$6N1557: C72.1 U15.6(BST)
$6N1559: C72.2 L4.1 U15.5(SW)
$6N1564: C71.1 U15.7(SS)
$6N1580: R32.1 R33.1 U15.8(FB)
$6N1585: C66.2 C67.2 C68.2 C69.2 C70.2 F6.1 L4.2 R35.2 R36.2
$6N1603: R34.2 R35.1
$6N1605: R33.2 R34.1
$6N12849: C100.2 F6.2 U21.1(VIN) U21.3(ON)
$7N2177: C88.2 U17.22(1V2O)
$7N2179: C87.2 U17.20(TOCAP)
$7N2183: R38.2 U17.10(EXRES1)
$7N2200: J3.9(D1+) R46.1
$7N2211: C86.2 J3.4 R43.1
$7N2220: C90.2 J3.5 R47.1 R48.1
$7N2225: J3.12(D4-) R44.1
$7N8984: C85.1 J3.6
$7N9022: C84.1 J3.3
$8N11191: F7.2 H1.1
$8N11344: LED3.1(K) R61.2
$9N804: R57.2 U20.3(A)
$9N828: LED1.4(DIN) LED2.4(DIN) R57.1
$9N1371: BZR1.2 D8.2(+) Q1.3(C)
$9N1449: Q1.1(B) R58.2

Not connected (* = marked no-connect by the designer): BZR1 3(NC)* 4(NC)*; J1 0* A1(GND)* A12(GND)* B1(GND)* B12*; J3 7*; LED1 1(DOUT)*; LED2 1(DOUT)*; M1 1*; M2 1*; M3 1*; M4 1*; M5 1*; SW1 3(NC)*; SW2 3(NC)*; U1 1(TDO/OUT0)* 2(TDI/OUT1)* 3(TMS/OUT2)* 4(TCK/OUT3)* 5(SIGIN/OUT7)* 6(SIGOUT)* 10(AUX1)* 11(AUX2)* 22(CLKOUT/OUT6)* 23(SCL)* 24(SDA)*; U2 1(N.C)*; U3 1(N.C)*; U4 1(N.C)*; U5 3(ALERT)*; U6 11(INT2)* 12(INT1)*; U13 1(RT)* 2(EN)*; U15 1(RT)* 2(EN)*; U17 7(DNC)* 12(NC)* 13(NC)* 18(VBG)* 24(SPDLED)* 26(DUPLED)* 38(RSVD)* 39(RSVD)* 40(RSVD)* 41(RSVD)* 42(RSVD)* 43(PMODE2)* 44(PMODE1)* 45(PMODE0)* 46(NC)* 47(NC)*; U21 4(NC)* 5(NC)*; U22 4(NC)* 5(NC)*

## Notes on the sheets
sheet 1
- SPI Config
- NFC Controller
- NFC Atenna
- Card Detection Switches
- Card Detect 1
- Card Detect 2
sheet 2
- Generic Screen/Expansion Interface
- General Purpose Button
- Temperautre Sensor
- Address: 1001000
- Tamper detection, screen auto-orientation
- Accelerometer
- Address: 0011001
- USB-C Port
- ESD Protection (Flow-Through Wiring)
- USB Current Limiting, Reverse Current Blocking
sheet 3
- Bus 15P Connection
- Bus GPIO Transceivers
- Level Shifting Capacitors
- When DIR is High, A goes to B
- DIR referenced to VCCA
- Default: Bus GPIO are inputs
- 1A Hold, 1.8A Trip Self-Healing Fuse
- Access Output Level Shift
sheet 4
- 3.3v 1A Regulator
- Runs on 12v or 5v, whichever is present
- 3.36v Actual
- 1A Hold
- 12v -> 5v 1A Regulator
- Ideal diode output to bus
- 5.04v Actual
sheet 5
- MISO Tri-State Buffer
- Power Rail Filtering
sheet 6
- Debug LED
- GPIO0 HIGH sets SPI boot
- GPIO0 and GPIO46 LOW sets firmware update mode
- GPIO45 must be LOW on boot - flash voltage level
- GPIO3 HIGH on boot - JTAG via USB
- UART Header
sheet 7
- The Card Slot hardware can be easily repurposed as hardware for a Tap Pad
- To convert from a card slot to a tap pad:
- Remove R51, populate R52
- Move RGB LED to LED2 position
- Replace side-fire buzzer with top-fire
- RGB Status LED
- Passive Buzzer
- This is how the MCU knows to act as a tap pad.
- Side Firing: MLT-8540 (C95300)
- This improves visibility, with the light facing towards the user.
- Top Firing: MLT-8540H (C95298)
- This improves sound percetion, since it will fire directly towards the user.
